# EasyEDA Pro project FOX_HTOL_1.0.eprj, board PCB1 (continued)
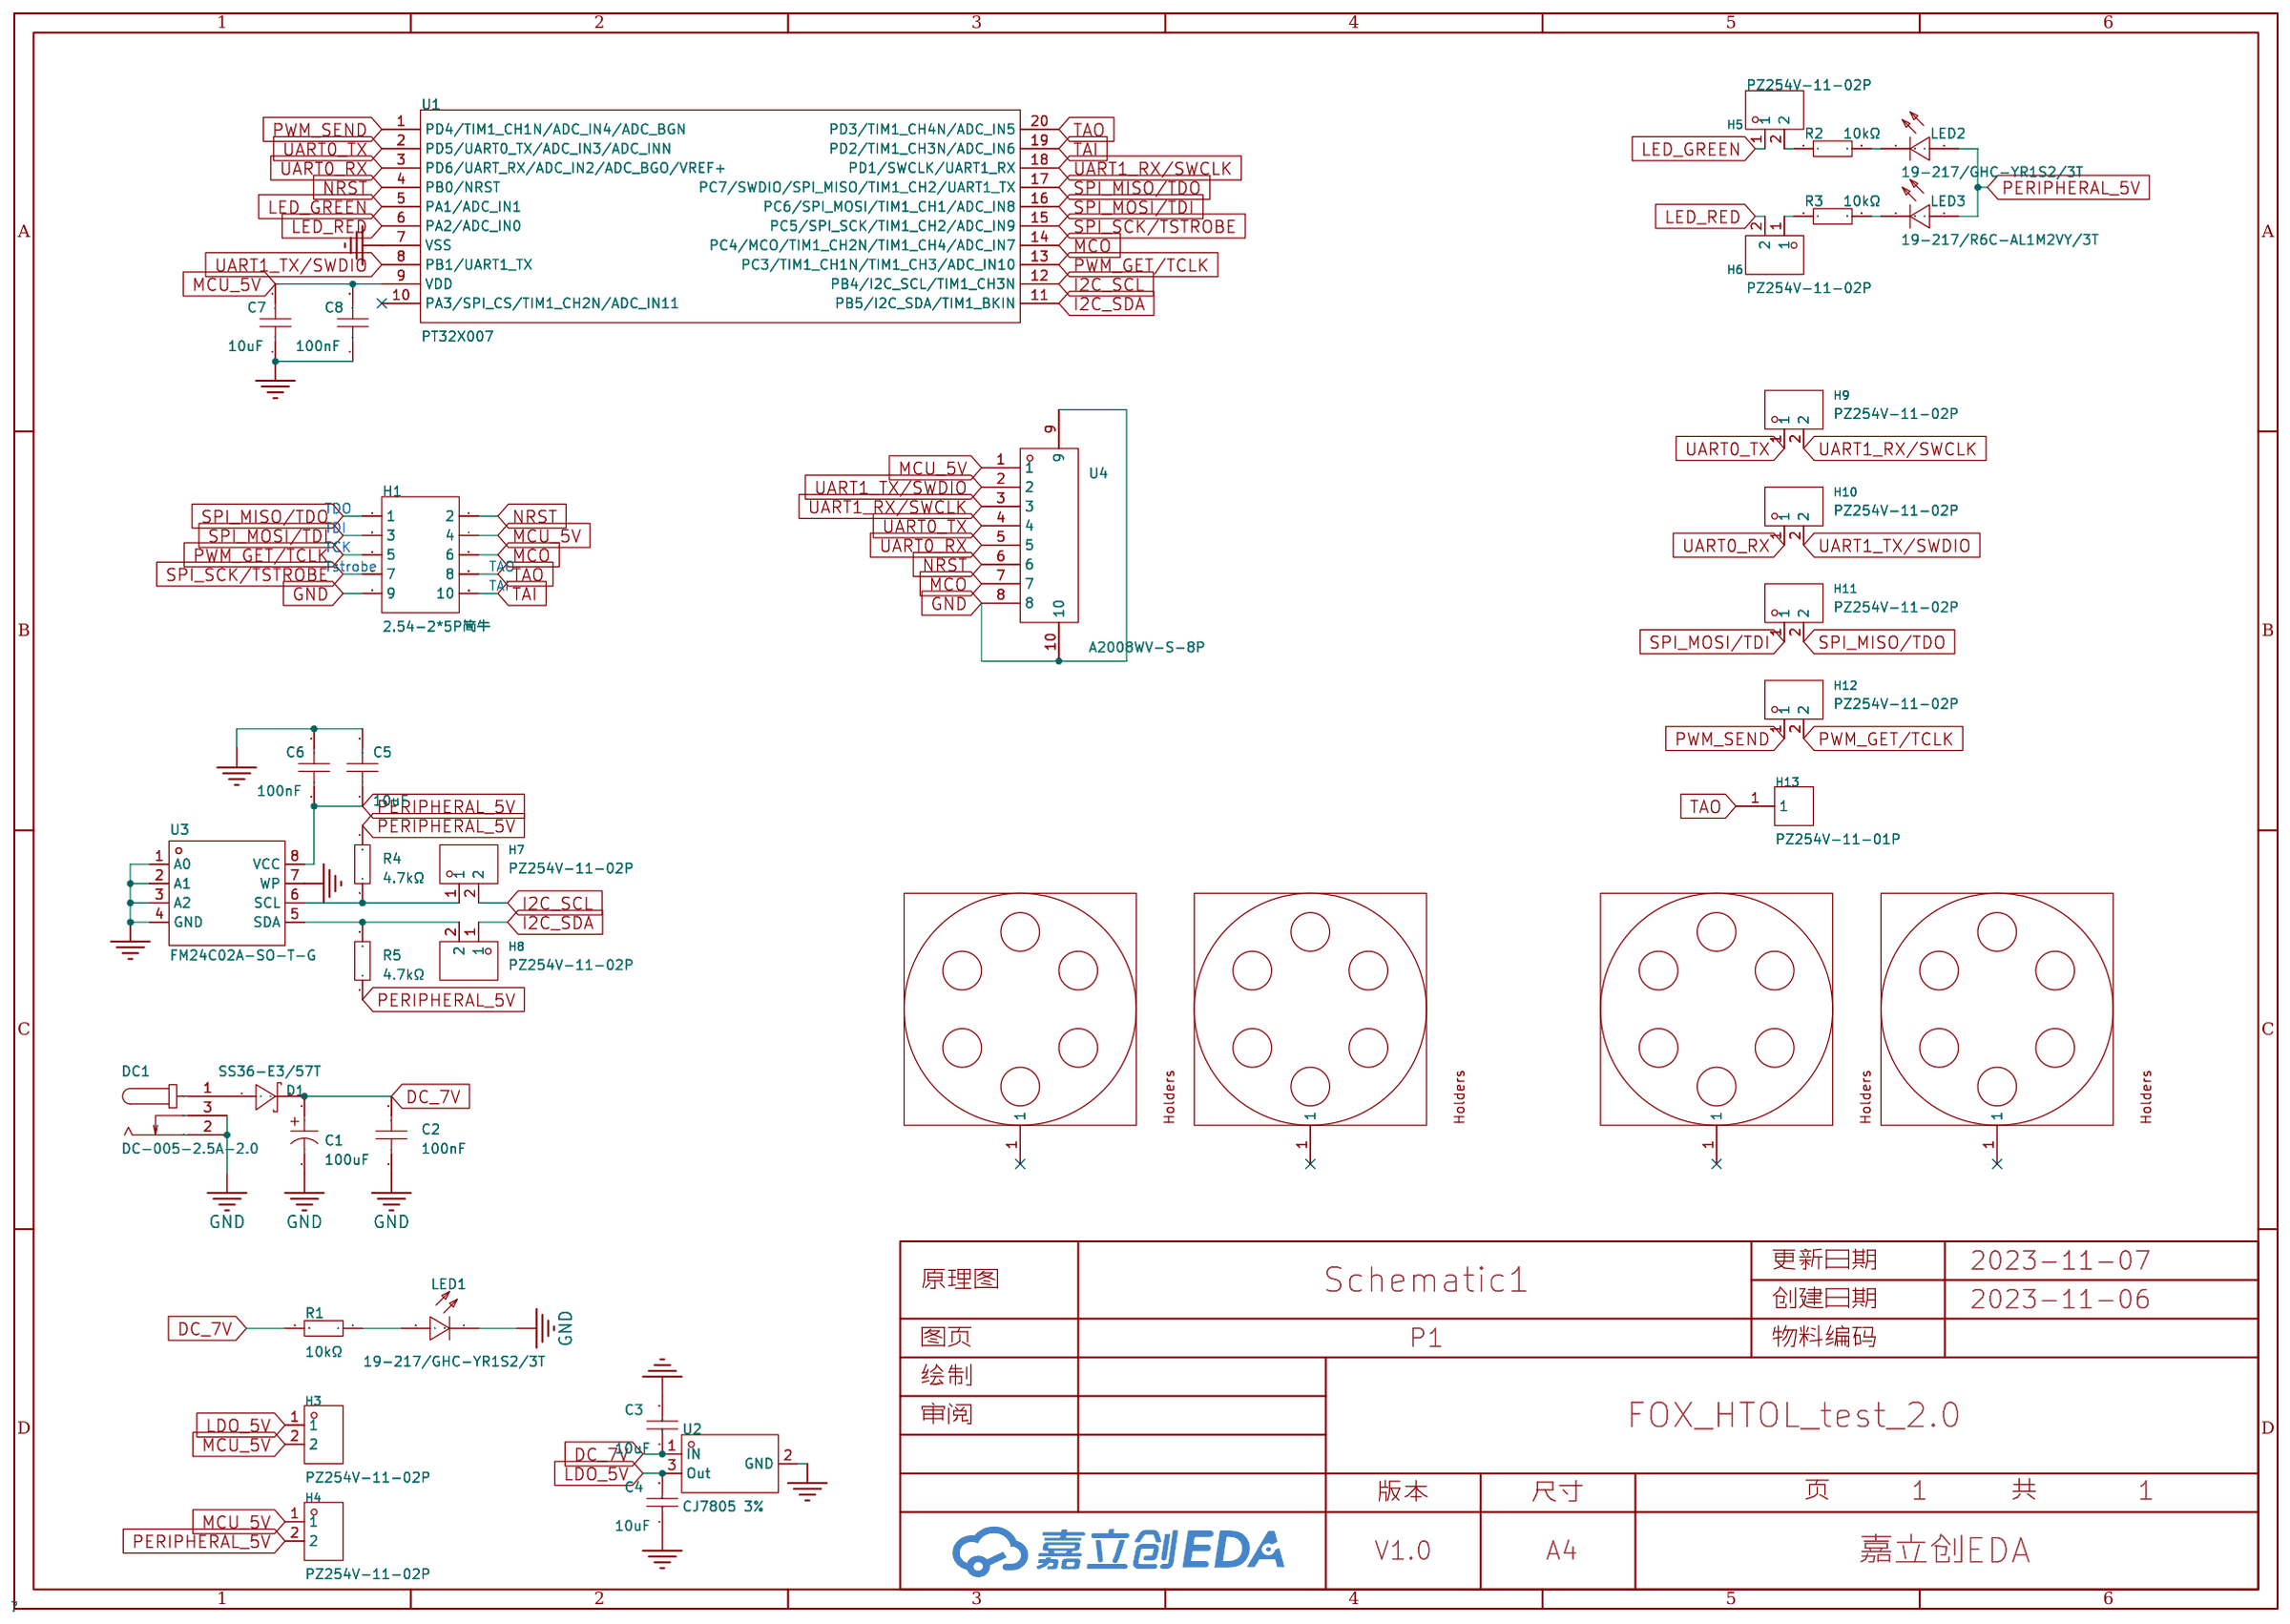
[diagram p0: schematic sheet]
## Placement (name value [footprint] x y rotation side) (continued)
H10#31  -  [HDR-TH_2P-P2.54-V-M]  46.04 191.02 180 top
H10#32  -  [HDR-TH_2P-P2.54-V-M]  46.04 94.65 180 top
H11  PZ254V-11-02P  [HDR-TH_2P-P2.54-V-M]  122.87 47.28 180 top
H11#2  -  [HDR-TH_2P-P2.54-V-M]  84.45 15.16 180 top
H11#3  -  [HDR-TH_2P-P2.54-V-M]  84.45 47.28 180 top
H11#4  -  [HDR-TH_2P-P2.54-V-M]  84.45 143.66 180 top
H11#5  -  [HDR-TH_2P-P2.54-V-M]  84.45 111.53 180 top
H11#6  -  [HDR-TH_2P-P2.54-V-M]  84.45 79.41 180 top
H11#7  -  [HDR-TH_2P-P2.54-V-M]  84.45 207.91 180 top
H11#8  -  [HDR-TH_2P-P2.54-V-M]  84.45 240.03 180 top
H11#9  -  [HDR-TH_2P-P2.54-V-M]  7.62 240.03 180 top
H11#10  -  [HDR-TH_2P-P2.54-V-M]  84.45 175.78 180 top
H11#11  -  [HDR-TH_2P-P2.54-V-M]  122.87 15.16 180 top
H11#12  -  [HDR-TH_2P-P2.54-V-M]  122.87 143.66 180 top
H11#13  -  [HDR-TH_2P-P2.54-V-M]  122.87 111.53 180 top
H11#14  -  [HDR-TH_2P-P2.54-V-M]  122.87 79.41 180 top
H11#15  -  [HDR-TH_2P-P2.54-V-M]  122.87 207.91 180 top
H11#16  -  [HDR-TH_2P-P2.54-V-M]  122.87 240.03 180 top
H11#17  -  [HDR-TH_2P-P2.54-V-M]  7.62 175.78 180 top
H11#18  -  [HDR-TH_2P-P2.54-V-M]  122.87 175.78 180 top
H11#19  -  [HDR-TH_2P-P2.54-V-M]  7.62 143.66 180 top
H11#20  -  [HDR-TH_2P-P2.54-V-M]  7.62 15.16 180 top
H11#21  -  [HDR-TH_2P-P2.54-V-M]  7.62 79.41 180 top
H11#22  -  [HDR-TH_2P-P2.54-V-M]  7.62 47.28 180 top
H11#23  -  [HDR-TH_2P-P2.54-V-M]  7.62 111.53 180 top
H11#24  -  [HDR-TH_2P-P2.54-V-M]  46.04 15.16 180 top
H11#25  -  [HDR-TH_2P-P2.54-V-M]  46.04 47.28 180 top
H11#26  -  [HDR-TH_2P-P2.54-V-M]  7.62 207.91 180 top
H11#27  -  [HDR-TH_2P-P2.54-V-M]  46.04 143.66 180 top
H11#28  -  [HDR-TH_2P-P2.54-V-M]  46.04 111.53 180 top
H11#29  -  [HDR-TH_2P-P2.54-V-M]  46.04 79.41 180 top
H11#30  -  [HDR-TH_2P-P2.54-V-M]  46.04 207.91 180 top
H11#31  -  [HDR-TH_2P-P2.54-V-M]  46.04 240.03 180 top
H11#32  -  [HDR-TH_2P-P2.54-V-M]  46.04 175.78 180 top
H12  PZ254V-11-02P  [HDR-TH_2P-P2.54-V-M]  84.45 228.23 180 top
H12#2  -  [HDR-TH_2P-P2.54-V-M]  84.45 131.85 180 top
H12#3  -  [HDR-TH_2P-P2.54-V-M]  84.45 99.73 180 top
H12#4  -  [HDR-TH_2P-P2.54-V-M]  84.45 35.48 180 top
H12#5  -  [HDR-TH_2P-P2.54-V-M]  84.45 260.35 180 top
H12#6  -  [HDR-TH_2P-P2.54-V-M]  84.45 196.1 180 top
H12#7  -  [HDR-TH_2P-P2.54-V-M]  84.45 163.98 180 top
H12#8  -  [HDR-TH_2P-P2.54-V-M]  84.45 67.6 180 top
H12#9  -  [HDR-TH_2P-P2.54-V-M]  122.87 35.48 180 top
H12#10  -  [HDR-TH_2P-P2.54-V-M]  7.62 260.35 180 top
H12#11  -  [HDR-TH_2P-P2.54-V-M]  122.87 228.23 180 top
H12#12  -  [HDR-TH_2P-P2.54-V-M]  122.87 131.85 180 top
H12#13  -  [HDR-TH_2P-P2.54-V-M]  122.87 99.73 180 top
H12#14  -  [HDR-TH_2P-P2.54-V-M]  122.87 260.35 180 top
H12#15  -  [HDR-TH_2P-P2.54-V-M]  122.87 196.1 180 top
H12#16  -  [HDR-TH_2P-P2.54-V-M]  122.87 163.98 180 top
H12#17  -  [HDR-TH_2P-P2.54-V-M]  122.87 67.6 180 top
H12#18  -  [HDR-TH_2P-P2.54-V-M]  7.62 163.98 180 top
H12#19  -  [HDR-TH_2P-P2.54-V-M]  7.62 35.48 180 top
H12#20  -  [HDR-TH_2P-P2.54-V-M]  7.62 67.6 180 top
H12#21  -  [HDR-TH_2P-P2.54-V-M]  7.62 99.73 180 top
H12#22  -  [HDR-TH_2P-P2.54-V-M]  7.62 131.85 180 top
H12#23  -  [HDR-TH_2P-P2.54-V-M]  7.62 228.23 180 top
H12#24  -  [HDR-TH_2P-P2.54-V-M]  46.04 228.23 180 top
H12#25  -  [HDR-TH_2P-P2.54-V-M]  46.04 131.85 180 top
H12#26  -  [HDR-TH_2P-P2.54-V-M]  46.04 99.73 180 top
H12#27  -  [HDR-TH_2P-P2.54-V-M]  46.04 35.48 180 top
H12#28  -  [HDR-TH_2P-P2.54-V-M]  46.04 260.35 180 top
H12#29  -  [HDR-TH_2P-P2.54-V-M]  46.04 196.1 180 top
H12#30  -  [HDR-TH_2P-P2.54-V-M]  46.04 163.98 180 top
H12#31  -  [HDR-TH_2P-P2.54-V-M]  46.04 67.6 180 top
H12#32  -  [HDR-TH_2P-P2.54-V-M]  7.62 196.1 180 top
H13  PZ254V-11-01P  [HDR-TH_1P-P2.54-V-M]  106.04 122.07 0 top
H13#2  -  [HDR-TH_1P-P2.54-V-M]  106.04 57.82 0 top
H13#3  -  [HDR-TH_1P-P2.54-V-M]  106.04 25.7 0 top
H13#4  -  [HDR-TH_1P-P2.54-V-M]  106.04 250.57 0 top
H13#5  -  [HDR-TH_1P-P2.54-V-M]  106.04 218.45 0 top
H13#6  -  [HDR-TH_1P-P2.54-V-M]  106.04 154.2 0 top
H13#7  -  [HDR-TH_1P-P2.54-V-M]  106.04 186.32 0 top
H13#8  -  [HDR-TH_1P-P2.54-V-M]  106.04 89.95 0 top
H13#9  -  [HDR-TH_1P-P2.54-V-M]  144.46 122.07 0 top
H13#10  -  [HDR-TH_1P-P2.54-V-M]  144.46 57.82 0 top
H13#11  -  [HDR-TH_1P-P2.54-V-M]  144.46 25.7 0 top
H13#12  -  [HDR-TH_1P-P2.54-V-M]  144.46 250.57 0 top
H13#13  -  [HDR-TH_1P-P2.54-V-M]  144.46 218.45 0 top
H13#14  -  [HDR-TH_1P-P2.54-V-M]  144.46 154.2 0 top
H13#15  -  [HDR-TH_1P-P2.54-V-M]  29.21 186.32 0 top
H13#16  -  [HDR-TH_1P-P2.54-V-M]  144.46 186.32 0 top
H13#17  -  [HDR-TH_1P-P2.54-V-M]  144.46 89.95 0 top
H13#18  -  [HDR-TH_1P-P2.54-V-M]  29.21 154.2 0 top
H13#19  -  [HDR-TH_1P-P2.54-V-M]  29.21 25.7 0 top
H13#20  -  [HDR-TH_1P-P2.54-V-M]  29.21 89.95 0 top
H13#21  -  [HDR-TH_1P-P2.54-V-M]  29.21 57.82 0 top
H13#22  -  [HDR-TH_1P-P2.54-V-M]  29.21 122.07 0 top
H13#23  -  [HDR-TH_1P-P2.54-V-M]  67.63 122.07 0 top
H13#24  -  [HDR-TH_1P-P2.54-V-M]  29.21 218.45 0 top
H13#25  -  [HDR-TH_1P-P2.54-V-M]  67.63 57.82 0 top
H13#26  -  [HDR-TH_1P-P2.54-V-M]  67.63 25.7 0 top
H13#27  -  [HDR-TH_1P-P2.54-V-M]  67.63 250.57 0 top
H13#28  -  [HDR-TH_1P-P2.54-V-M]  67.63 218.45 0 top
H13#29  -  [HDR-TH_1P-P2.54-V-M]  67.63 154.2 0 top
H13#30  -  [HDR-TH_1P-P2.54-V-M]  29.21 250.57 0 top
H13#31  -  [HDR-TH_1P-P2.54-V-M]  67.63 186.32 0 top
H13#32  -  [HDR-TH_1P-P2.54-V-M]  67.63 89.95 0 top
J2  -  [DEMO板安装孔]  152.23 273.68 0 top
J3  -  [DEMO板安装孔]  9.52 273.68 0 top
J4  -  [DEMO板安装孔]  9.27 5.07 0 top
J5  -  [DEMO板安装孔]  152.02 4.95 0 top
LED1  19-217/GHC-YR1S2/3T  [LED0603-RD]  34.8 279.4 90 top
LED2  19-217/GHC-YR1S2/3T  [LED0603-RD]  25.55 238.52 180 top
LED2#2  -  [LED0603-RD]  102.38 13.65 180 top
LED2#3  -  [LED0603-RD]  102.38 238.52 180 top
LED2#4  -  [LED0603-RD]  102.38 206.39 180 top
LED2#5  -  [LED0603-RD]  102.38 174.27 180 top
LED2#6  -  [LED0603-RD]  25.55 174.27 180 top
LED2#7  -  [LED0603-RD]  102.38 45.77 180 top
LED2#8  -  [LED0603-RD]  102.38 142.14 180 top
LED2#9  -  [LED0603-RD]  102.38 110.02 180 top
LED2#10  -  [LED0603-RD]  102.38 77.89 180 top
LED2#11  -  [LED0603-RD]  140.8 13.65 180 top
LED2#12  -  [LED0603-RD]  140.8 238.52 180 top
LED2#13  -  [LED0603-RD]  140.8 206.39 180 top
LED2#14  -  [LED0603-RD]  140.8 174.27 180 top
LED2#15  -  [LED0603-RD]  140.8 45.77 180 top
LED2#16  -  [LED0603-RD]  140.8 142.14 180 top
LED2#17  -  [LED0603-RD]  140.8 110.02 180 top
LED2#18  -  [LED0603-RD]  140.8 77.89 180 top
LED2#19  -  [LED0603-RD]  25.55 142.14 180 top
LED2#20  -  [LED0603-RD]  25.55 13.65 180 top
LED2#21  -  [LED0603-RD]  25.55 77.89 180 top
LED2#22  -  [LED0603-RD]  25.55 45.77 180 top
LED2#23  -  [LED0603-RD]  25.55 110.02 180 top
LED2#24  -  [LED0603-RD]  25.55 206.39 180 top
LED2#25  -  [LED0603-RD]  63.97 13.65 180 top
LED2#26  -  [LED0603-RD]  63.97 238.52 180 top
LED2#27  -  [LED0603-RD]  63.97 206.39 180 top
LED2#28  -  [LED0603-RD]  63.97 174.27 180 top
LED2#29  -  [LED0603-RD]  63.97 45.77 180 top
LED2#30  -  [LED0603-RD]  63.97 142.14 180 top
LED2#31  -  [LED0603-RD]  63.97 110.02 180 top
LED2#32  -  [LED0603-RD]  63.97 77.89 180 top
LED3  19-217/R6C-AL1M2VY/3T  [LED0603-RD]  102.36 144.04 180 top
LED3#2  -  [LED0603-RD]  25.53 176.16 180 top
LED3#3  -  [LED0603-RD]  25.53 240.41 180 top
LED3#4  -  [LED0603-RD]  102.36 15.54 180 top
LED3#5  -  [LED0603-RD]  102.36 208.29 180 top
LED3#6  -  [LED0603-RD]  102.36 79.79 180 top
LED3#7  -  [LED0603-RD]  102.36 240.41 180 top
LED3#8  -  [LED0603-RD]  102.36 47.66 180 top
LED3#9  -  [LED0603-RD]  102.36 176.16 180 top
LED3#10  -  [LED0603-RD]  102.36 111.91 180 top
LED3#11  -  [LED0603-RD]  140.77 15.54 180 top
LED3#12  -  [LED0603-RD]  140.77 208.29 180 top
LED3#13  -  [LED0603-RD]  140.77 79.79 180 top
LED3#14  -  [LED0603-RD]  140.77 240.41 180 top
LED3#15  -  [LED0603-RD]  140.77 144.04 180 top
LED3#16  -  [LED0603-RD]  140.77 47.66 180 top
LED3#17  -  [LED0603-RD]  140.77 176.16 180 top
LED3#18  -  [LED0603-RD]  140.77 111.91 180 top
LED3#19  -  [LED0603-RD]  25.53 144.04 180 top
LED3#20  -  [LED0603-RD]  25.53 15.54 180 top
LED3#21  -  [LED0603-RD]  25.53 79.79 180 top
LED3#22  -  [LED0603-RD]  25.53 47.66 180 top
LED3#23  -  [LED0603-RD]  25.53 111.91 180 top
LED3#24  -  [LED0603-RD]  25.53 208.29 180 top
LED3#25  -  [LED0603-RD]  63.94 15.54 180 top
LED3#26  -  [LED0603-RD]  63.94 208.29 180 top
LED3#27  -  [LED0603-RD]  63.94 79.79 180 top
LED3#28  -  [LED0603-RD]  63.94 240.41 180 top
LED3#29  -  [LED0603-RD]  63.94 144.04 180 top
LED3#30  -  [LED0603-RD]  63.94 47.66 180 top
LED3#31  -  [LED0603-RD]  63.94 176.16 180 top
LED3#32  -  [LED0603-RD]  63.94 111.91 180 top
R1  10kΩ  [R0603]  34.8 282.45 90 top
R2  10kΩ  [R0603]  28.7 238.51 180 top
R2#2  -  [R0603]  105.53 142.13 180 top
R2#3  -  [R0603]  105.53 13.63 180 top
R2#4  -  [R0603]  105.53 206.38 180 top
R2#5  -  [R0603]  105.53 174.26 180 top
R2#6  -  [R0603]  28.7 174.26 180 top
R2#7  -  [R0603]  105.53 77.88 180 top
R2#8  -  [R0603]  105.53 45.76 180 top
R2#9  -  [R0603]  105.53 238.51 180 top
R2#10  -  [R0603]  105.53 110.01 180 top
R2#11  -  [R0603]  143.95 142.13 180 top
R2#12  -  [R0603]  143.95 13.63 180 top
R2#13  -  [R0603]  143.95 206.38 180 top
R2#14  -  [R0603]  143.95 174.26 180 top
R2#15  -  [R0603]  143.95 77.88 180 top
R2#16  -  [R0603]  143.95 45.76 180 top
R2#17  -  [R0603]  143.95 238.51 180 top
R2#18  -  [R0603]  143.95 110.01 180 top
R2#19  -  [R0603]  28.7 142.13 180 top
R2#20  -  [R0603]  28.7 13.63 180 top
R2#21  -  [R0603]  28.7 77.88 180 top
R2#22  -  [R0603]  28.7 45.76 180 top
R2#23  -  [R0603]  28.7 110.01 180 top
R2#24  -  [R0603]  28.7 206.38 180 top
R2#25  -  [R0603]  67.12 142.13 180 top
R2#26  -  [R0603]  67.12 13.63 180 top
R2#27  -  [R0603]  67.12 206.38 180 top
R2#28  -  [R0603]  67.12 174.26 180 top
R2#29  -  [R0603]  67.12 77.88 180 top
R2#30  -  [R0603]  67.12 45.76 180 top
R2#31  -  [R0603]  67.12 238.51 180 top
R2#32  -  [R0603]  67.12 110.01 180 top
R3  10kΩ  [R0603]  105.54 79.79 180 top
R3#2  -  [R0603]  28.71 240.41 180 top
R3#3  -  [R0603]  105.54 208.29 180 top
R3#4  -  [R0603]  105.54 144.04 180 top
R3#5  -  [R0603]  105.54 111.92 180 top
R3#6  -  [R0603]  105.54 15.54 180 top
R3#7  -  [R0603]  105.54 47.67 180 top
R3#8  -  [R0603]  105.54 240.41 180 top
R3#9  -  [R0603]  105.54 176.17 180 top
R3#10  -  [R0603]  143.95 79.79 180 top
R3#11  -  [R0603]  28.71 176.17 180 top
R3#12  -  [R0603]  143.95 208.29 180 top
R3#13  -  [R0603]  143.95 144.04 180 top
R3#14  -  [R0603]  143.95 111.92 180 top
R3#15  -  [R0603]  143.95 15.54 180 top
R3#16  -  [R0603]  143.95 47.67 180 top
R3#17  -  [R0603]  143.95 240.41 180 top
R3#18  -  [R0603]  143.95 176.17 180 top
R3#19  -  [R0603]  28.71 144.04 180 top
R3#20  -  [R0603]  28.71 79.79 180 top
R3#21  -  [R0603]  28.71 15.54 180 top
R3#22  -  [R0603]  28.71 47.67 180 top
R3#23  -  [R0603]  28.71 111.92 180 top
R3#24  -  [R0603]  28.71 208.29 180 top
R3#25  -  [R0603]  67.12 79.79 180 top
R3#26  -  [R0603]  67.12 208.29 180 top
R3#27  -  [R0603]  67.12 144.04 180 top
R3#28  -  [R0603]  67.12 111.92 180 top
R3#29  -  [R0603]  67.12 15.54 180 top
R3#30  -  [R0603]  67.12 47.67 180 top
R3#31  -  [R0603]  67.12 240.41 180 top
R3#32  -  [R0603]  67.12 176.17 180 top
R4  4.7kΩ  [R0603]  98.04 142.26 0 top
R4#2  -  [R0603]  98.04 206.51 0 top
R4#3  -  [R0603]  21.21 238.63 0 top
R4#4  -  [R0603]  98.04 78.01 0 top
R4#5  -  [R0603]  98.04 13.76 0 top
R4#6  -  [R0603]  98.04 45.89 0 top
R4#7  -  [R0603]  98.04 238.63 0 top
R4#8  -  [R0603]  98.04 174.38 0 top
R4#9  -  [R0603]  98.04 110.14 0 top
R4#10  -  [R0603]  136.46 206.51 0 top
R4#11  -  [R0603]  136.46 78.01 0 top
R4#12  -  [R0603]  136.46 13.76 0 top
R4#13  -  [R0603]  136.46 142.26 0 top
R4#14  -  [R0603]  136.46 45.89 0 top
R4#15  -  [R0603]  136.46 238.63 0 top
R4#16  -  [R0603]  136.46 174.38 0 top
R4#17  -  [R0603]  21.21 174.38 0 top
R4#18  -  [R0603]  136.46 110.14 0 top
R4#19  -  [R0603]  21.21 142.26 0 top
R4#20  -  [R0603]  21.21 78.01 0 top
R4#21  -  [R0603]  21.21 13.76 0 top
R4#22  -  [R0603]  21.21 45.89 0 top
R4#23  -  [R0603]  21.21 110.14 0 top
R4#24  -  [R0603]  21.21 206.51 0 top
R4#25  -  [R0603]  59.62 206.51 0 top
R4#26  -  [R0603]  59.62 78.01 0 top
R4#27  -  [R0603]  59.62 13.76 0 top
R4#28  -  [R0603]  59.62 142.26 0 top
R4#29  -  [R0603]  59.62 45.89 0 top
R4#30  -  [R0603]  59.62 238.63 0 top
R4#31  -  [R0603]  59.62 174.38 0 top
R4#32  -  [R0603]  59.62 110.14 0 top
R5  4.7kΩ  [R0603]  21.21 108.61 180 top
R5#2  -  [R0603]  98.04 140.74 180 top
R5#3  -  [R0603]  98.04 108.61 180 top
R5#4  -  [R0603]  21.21 237.11 180 top
R5#5  -  [R0603]  98.04 76.49 180 top
R5#6  -  [R0603]  98.04 204.98 180 top
R5#7  -  [R0603]  98.04 172.86 180 top
R5#8  -  [R0603]  98.04 44.36 180 top
R5#9  -  [R0603]  98.04 237.11 180 top
R5#10  -  [R0603]  136.46 12.24 180 top
R5#11  -  [R0603]  136.46 140.74 180 top
R5#12  -  [R0603]  136.46 108.61 180 top
R5#13  -  [R0603]  136.46 76.49 180 top
R5#14  -  [R0603]  136.46 204.98 180 top
R5#15  -  [R0603]  136.46 172.86 180 top
R5#16  -  [R0603]  136.46 44.36 180 top
R5#17  -  [R0603]  136.46 237.11 180 top
R5#18  -  [R0603]  21.21 172.86 180 top
R5#19  -  [R0603]  21.21 140.74 180 top
R5#20  -  [R0603]  21.21 12.24 180 top
R5#21  -  [R0603]  21.21 76.49 180 top
R5#22  -  [R0603]  21.21 44.36 180 top
R5#23  -  [R0603]  59.62 12.24 180 top
R5#24  -  [R0603]  59.62 140.74 180 top
R5#25  -  [R0603]  59.62 108.61 180 top
R5#26  -  [R0603]  59.62 76.49 180 top
R5#27  -  [R0603]  59.62 204.98 180 top
R5#28  -  [R0603]  59.62 172.86 180 top
R5#29  -  [R0603]  21.21 204.98 180 top
R5#30  -  [R0603]  59.62 44.36 180 top
R5#31  -  [R0603]  59.62 237.11 180 top
R5#32  -  [R0603]  98.04 12.24 180 top
U1  PT32X007  [TSSOP-20_L6.5-W4.4-P0.65-LS6.4-BL]  21.08 248.16 270 top
U1#2  -  [TSSOP-20_L6.5-W4.4-P0.65-LS6.4-BL]  97.91 119.66 270 top
U1#3  -  [TSSOP-20_L6.5-W4.4-P0.65-LS6.4-BL]  97.91 55.41 270 top
U1#4  -  [TSSOP-20_L6.5-W4.4-P0.65-LS6.4-BL]  97.91 23.29 270 top
U1#5  -  [TSSOP-20_L6.5-W4.4-P0.65-LS6.4-BL]  97.91 216.03 270 top
U1#6  -  [TSSOP-20_L6.5-W4.4-P0.65-LS6.4-BL]  97.91 87.54 270 top
U1#7  -  [TSSOP-20_L6.5-W4.4-P0.65-LS6.4-BL]  97.91 248.16 270 top
U1#8  -  [TSSOP-20_L6.5-W4.4-P0.65-LS6.4-BL]  97.91 183.91 270 top
U1#9  -  [TSSOP-20_L6.5-W4.4-P0.65-LS6.4-BL]  97.91 151.78 270 top
U1#10  -  [TSSOP-20_L6.5-W4.4-P0.65-LS6.4-BL]  136.33 119.66 270 top
U1#11  -  [TSSOP-20_L6.5-W4.4-P0.65-LS6.4-BL]  136.33 55.41 270 top
U1#12  -  [TSSOP-20_L6.5-W4.4-P0.65-LS6.4-BL]  136.33 23.29 270 top
U1#13  -  [TSSOP-20_L6.5-W4.4-P0.65-LS6.4-BL]  136.33 216.03 270 top
U1#14  -  [TSSOP-20_L6.5-W4.4-P0.65-LS6.4-BL]  136.33 87.54 270 top
U1#15  -  [TSSOP-20_L6.5-W4.4-P0.65-LS6.4-BL]  136.33 248.16 270 top
U1#16  -  [TSSOP-20_L6.5-W4.4-P0.65-LS6.4-BL]  136.33 183.91 270 top
U1#17  -  [TSSOP-20_L6.5-W4.4-P0.65-LS6.4-BL]  136.33 151.78 270 top
U1#18  -  [TSSOP-20_L6.5-W4.4-P0.65-LS6.4-BL]  21.08 151.78 270 top
U1#19  -  [TSSOP-20_L6.5-W4.4-P0.65-LS6.4-BL]  21.08 23.29 270 top
U1#20  -  [TSSOP-20_L6.5-W4.4-P0.65-LS6.4-BL]  21.08 87.54 270 top
U1#21  -  [TSSOP-20_L6.5-W4.4-P0.65-LS6.4-BL]  21.08 55.41 270 top
U1#22  -  [TSSOP-20_L6.5-W4.4-P0.65-LS6.4-BL]  21.08 119.66 270 top
U1#23  -  [TSSOP-20_L6.5-W4.4-P0.65-LS6.4-BL]  21.08 216.03 270 top
U1#24  -  [TSSOP-20_L6.5-W4.4-P0.65-LS6.4-BL]  59.5 119.66 270 top
U1#25  -  [TSSOP-20_L6.5-W4.4-P0.65-LS6.4-BL]  59.5 55.41 270 top
U1#26  -  [TSSOP-20_L6.5-W4.4-P0.65-LS6.4-BL]  59.5 23.29 270 top
U1#27  -  [TSSOP-20_L6.5-W4.4-P0.65-LS6.4-BL]  59.5 216.03 270 top
U1#28  -  [TSSOP-20_L6.5-W4.4-P0.65-LS6.4-BL]  59.5 87.54 270 top
U1#29  -  [TSSOP-20_L6.5-W4.4-P0.65-LS6.4-BL]  59.5 248.16 270 top
U1#30  -  [TSSOP-20_L6.5-W4.4-P0.65-LS6.4-BL]  59.5 183.91 270 top
U1#31  -  [TSSOP-20_L6.5-W4.4-P0.65-LS6.4-BL]  21.08 183.91 270 top
U1#32  -  [TSSOP-20_L6.5-W4.4-P0.65-LS6.4-BL]  59.5 151.78 270 top
U2  CJ7805 3%  [TO-252-2_L6.6-W6.1-P4.58-LS10.1-BR-CW]  57.62 280.98 180 top
U2#2  -  [TO-252-2_L6.6-W6.1-P4.58-LS10.1-BR-CW]  72.35 280.98 180 top
U2#3  -  [TO-252-2_L6.6-W6.1-P4.58-LS10.1-BR-CW]  42.8 280.92 180 top
U2#4  -  [TO-252-2_L6.6-W6.1-P4.58-LS10.1-BR-CW]  87.09 280.98 180 top
U3  FM24C02A-SO-T-G  [SOP-8_L5.0-W4.0-P1.27-LS6.2-BL]  92.58 47.28 270 top
U3#2  -  [SOP-8_L5.0-W4.0-P1.27-LS6.2-BL]  92.58 207.91 270 top
U3#3  -  [SOP-8_L5.0-W4.0-P1.27-LS6.2-BL]  92.58 15.16 270 top
U3#4  -  [SOP-8_L5.0-W4.0-P1.27-LS6.2-BL]  92.58 240.03 270 top
U3#5  -  [SOP-8_L5.0-W4.0-P1.27-LS6.2-BL]  15.75 240.03 270 top
U3#6  -  [SOP-8_L5.0-W4.0-P1.27-LS6.2-BL]  92.58 175.78 270 top
U3#7  -  [SOP-8_L5.0-W4.0-P1.27-LS6.2-BL]  92.58 143.66 270 top
U3#8  -  [SOP-8_L5.0-W4.0-P1.27-LS6.2-BL]  92.58 111.53 270 top
U3#9  -  [SOP-8_L5.0-W4.0-P1.27-LS6.2-BL]  92.58 79.41 270 top
U3#10  -  [SOP-8_L5.0-W4.0-P1.27-LS6.2-BL]  131 47.28 270 top
U3#11  -  [SOP-8_L5.0-W4.0-P1.27-LS6.2-BL]  131 207.91 270 top
U3#12  -  [SOP-8_L5.0-W4.0-P1.27-LS6.2-BL]  131 15.16 270 top
U3#13  -  [SOP-8_L5.0-W4.0-P1.27-LS6.2-BL]  131 240.03 270 top
U3#14  -  [SOP-8_L5.0-W4.0-P1.27-LS6.2-BL]  131 175.78 270 top
U3#15  -  [SOP-8_L5.0-W4.0-P1.27-LS6.2-BL]  131 143.66 270 top
U3#16  -  [SOP-8_L5.0-W4.0-P1.27-LS6.2-BL]  131 111.53 270 top
U3#17  -  [SOP-8_L5.0-W4.0-P1.27-LS6.2-BL]  131 79.41 270 top
U3#18  -  [SOP-8_L5.0-W4.0-P1.27-LS6.2-BL]  15.75 175.78 270 top
U3#19  -  [SOP-8_L5.0-W4.0-P1.27-LS6.2-BL]  15.75 143.66 270 top
U3#20  -  [SOP-8_L5.0-W4.0-P1.27-LS6.2-BL]  15.75 79.41 270 top
U3#21  -  [SOP-8_L5.0-W4.0-P1.27-LS6.2-BL]  15.75 15.16 270 top
U3#22  -  [SOP-8_L5.0-W4.0-P1.27-LS6.2-BL]  15.75 47.28 270 top
U3#23  -  [SOP-8_L5.0-W4.0-P1.27-LS6.2-BL]  15.75 111.53 270 top
U3#24  -  [SOP-8_L5.0-W4.0-P1.27-LS6.2-BL]  15.75 207.91 270 top
U3#25  -  [SOP-8_L5.0-W4.0-P1.27-LS6.2-BL]  54.16 47.28 270 top
U3#26  -  [SOP-8_L5.0-W4.0-P1.27-LS6.2-BL]  54.16 207.91 270 top
U3#27  -  [SOP-8_L5.0-W4.0-P1.27-LS6.2-BL]  54.16 15.16 270 top
U3#28  -  [SOP-8_L5.0-W4.0-P1.27-LS6.2-BL]  54.16 240.03 270 top
U3#29  -  [SOP-8_L5.0-W4.0-P1.27-LS6.2-BL]  54.16 175.78 270 top
U3#30  -  [SOP-8_L5.0-W4.0-P1.27-LS6.2-BL]  54.16 143.66 270 top
U3#31  -  [SOP-8_L5.0-W4.0-P1.27-LS6.2-BL]  54.16 111.53 270 top
U3#32  -  [SOP-8_L5.0-W4.0-P1.27-LS6.2-BL]  54.16 79.41 270 top
U4  A2008WV-S-8P  [CONN-SMD_A2008WV-S-8P]  113.66 90.96 270 top
U4#2  -  [CONN-SMD_A2008WV-S-8P]  113.66 58.84 270 top
U4#3  -  [CONN-SMD_A2008WV-S-8P]  113.66 26.72 270 top
U4#4  -  [CONN-SMD_A2008WV-S-8P]  113.66 187.34 270 top
U4#5  -  [CONN-SMD_A2008WV-S-8P]  113.66 155.21 270 top
U4#6  -  [CONN-SMD_A2008WV-S-8P]  113.66 251.59 270 top
U4#7  -  [CONN-SMD_A2008WV-S-8P]  113.66 219.46 270 top
U4#8  -  [CONN-SMD_A2008WV-S-8P]  113.66 123.09 270 top
U4#9  -  [CONN-SMD_A2008WV-S-8P]  36.83 251.59 270 top
U4#10  -  [CONN-SMD_A2008WV-S-8P]  152.08 90.96 270 top
U4#11  -  [CONN-SMD_A2008WV-S-8P]  152.08 58.84 270 top
U4#12  -  [CONN-SMD_A2008WV-S-8P]  152.08 26.72 270 top
U4#13  -  [CONN-SMD_A2008WV-S-8P]  152.08 187.34 270 top
U4#14  -  [CONN-SMD_A2008WV-S-8P]  152.08 155.21 270 top
U4#15  -  [CONN-SMD_A2008WV-S-8P]  152.08 251.59 270 top
U4#16  -  [CONN-SMD_A2008WV-S-8P]  152.08 219.46 270 top
U4#17  -  [CONN-SMD_A2008WV-S-8P]  152.08 123.09 270 top
U4#18  -  [CONN-SMD_A2008WV-S-8P]  36.83 187.34 270 top
U4#19  -  [CONN-SMD_A2008WV-S-8P]  36.83 155.21 270 top
U4#20  -  [CONN-SMD_A2008WV-S-8P]  36.83 26.72 270 top
U4#21  -  [CONN-SMD_A2008WV-S-8P]  36.83 58.84 270 top
U4#22  -  [CONN-SMD_A2008WV-S-8P]  36.83 90.96 270 top
U4#23  -  [CONN-SMD_A2008WV-S-8P]  36.83 123.09 270 top
U4#24  -  [CONN-SMD_A2008WV-S-8P]  75.25 90.96 270 top
U4#25  -  [CONN-SMD_A2008WV-S-8P]  75.25 58.84 270 top
U4#26  -  [CONN-SMD_A2008WV-S-8P]  75.25 26.72 270 top
U4#27  -  [CONN-SMD_A2008WV-S-8P]  75.25 187.34 270 top
U4#28  -  [CONN-SMD_A2008WV-S-8P]  75.25 155.21 270 top
U4#29  -  [CONN-SMD_A2008WV-S-8P]  75.25 251.59 270 top
U4#30  -  [CONN-SMD_A2008WV-S-8P]  75.25 219.46 270 top
U4#31  -  [CONN-SMD_A2008WV-S-8P]  36.83 219.46 270 top
U4#32  -  [CONN-SMD_A2008WV-S-8P]  75.25 123.09 270 top

## Footprints (pads in the part's own frame, mm; a bottom-side part is the same pattern mirrored in y, then rotated)
C0603
  rect 0.8x0.9 smd: 1(-0.7,0) 2(0.7,0)
C1206
  rect 1.485x1.728 smd: 1(-1.593,0) 2(1.593,0)
CAP-SMD_BD6.3-L6.6-W6.6-LS7.6-FD-1
  rect 3.5x1.2 smd: 1(-2.67,0) 2(2.67,0)
CONN-SMD_A2008WV-S-8P
  rect 1x2.5 smd: 1(-7,1.724) 2(-5,1.724) 3(-3,1.724) 4(-1,1.724) 5(1,1.724) 6(2.999,1.724) 7(5,1.724) 8(7,1.724)
  rect 1.55x2.6 smd: 9(-9.575,-1.724) 10(9.575,-1.724)
CONN-TH_DC-005-2.5A-2.0
  oval 1.8x4.2 hole 1.2x3.7: 1(2.999,2.35) 2(-2.999,2.35)
  oval 4.2x1.8 hole 3.7x1.2: 3(0,-2.35)
DEMO板安装孔
  round 6.32 hole 3: 1(0,0)
HDR-TH_1P-P2.54-V-M
  rect 1.7x1.7 hole 1.1: 1(0,0)
HDR-TH_2P-P2.54-V-M
  rect 2x2 hole 1.2: 1(-1.27,0)
  round 2 hole 1.2: 2(1.27,0)
IDC-TH_10P-P2.54_C5665
  round 1.524 hole 1: 1(-5.08,-1.27) 2(-5.08,1.27) 3(-2.54,-1.27) 4(-2.54,1.27) 5(0,-1.27) 6(0,1.27) 7(2.54,-1.27) 8(2.54,1.27) 9(5.08,-1.27) 10(5.08,1.27)
LED0603-RD
  rect 0.8x0.8 smd: 1(-0.799,-0.004) 2(0.799,0.004)
R0603
  rect 0.806x0.864 smd: 1(-0.753,0) 2(0.753,0)
SMC_L7.1-W6.2-LS8.1-R-RD
  rect 3.03x3.82 smd: 1(3.435,0) 2(-3.435,0)
SOP-8_L5.0-W4.0-P1.27-LS6.2-BL
  oval 0.7x1.7 smd: 1(-1.905,-2.9) 2(-0.635,-2.9) 3(0.635,-2.9) 4(1.905,-2.9) 5(1.905,2.9) 6(0.635,2.9) 7(-0.635,2.9) 8(-1.905,2.9)
TO-252-2_L6.6-W6.1-P4.58-LS10.1-BR-CW
  rect 2.364x1.064 smd: 1(3.462,-2.286) 3(3.462,2.286)
  rect 6.004x5.512 smd: 2(-3.462,0)
TSSOP-20_L6.5-W4.4-P0.65-LS6.4-BL
  oval 0.364x1.742 smd: 1(-2.925,-2.871) 2(-2.275,-2.871) 3(-1.625,-2.871) 4(-0.975,-2.871) 5(-0.325,-2.871) 6(0.325,-2.871) 7(0.975,-2.871) 8(1.625,-2.871) 9(2.275,-2.871) 10(2.925,-2.871) 11(2.925,2.871) 12(2.275,2.871) 13(1.625,2.871) 14(0.975,2.871) 15(0.325,2.871) 16(-0.325,2.871) 17(-0.975,2.871) 18(-1.625,2.871) 19(-2.275,2.871) 20(-2.925,2.871)

## Nets
GND: C1.2 C2.1 C3.2 C3#2.2 C3#3.2 C3#4.2 C4.1 C4#2.1 C4#3.1 C4#4.1 C5.2 C5#2.2 C5#3.2 C5#4.2 C5#5.2 C5#6.2 C5#7.2 C5#8.2 C5#9.2 C5#10.2 C5#11.2 C5#12.2 C5#13.2 C5#14.2 C5#15.2 C5#16.2 C5#17.2 C5#18.2 C5#19.2 C5#20.2 C5#21.2 C5#22.2 C5#23.2 C5#24.2 C5#25.2 C5#26.2 C5#27.2 C5#28.2 C5#29.2 C5#30.2 C5#31.2 C5#32.2 C6.2 C6#2.2 C6#3.2 C6#4.2 C6#5.2 C6#6.2 C6#7.2 C6#8.2 C6#9.2 C6#10.2 C6#11.2 C6#12.2 C6#13.2 C6#14.2 C6#15.2 C6#16.2 C6#17.2 C6#18.2 C6#19.2 C6#20.2 C6#21.2 C6#22.2 C6#23.2 C6#24.2 C6#25.2 C6#26.2 C6#27.2 C6#28.2 C6#29.2 C6#30.2 C6#31.2 C6#32.2 C7.1 C7#2.1 C7#3.1 C7#4.1 C7#5.1 C7#6.1 C7#7.1 C7#8.1 C7#9.1 C7#10.1 C7#11.1 C7#12.1 C7#13.1 C7#14.1 C7#15.1 C7#16.1 C7#17.1 C7#18.1 C7#19.1 C7#20.1 C7#21.1 C7#22.1 C7#23.1 C7#24.1 C7#25.1 C7#26.1 C7#27.1 C7#28.1 C7#29.1 C7#30.1 C7#31.1 C7#32.1 C8.1 C8#2.1 C8#3.1 C8#4.1 C8#5.1 C8#6.1 C8#7.1 C8#8.1 C8#9.1 C8#10.1 C8#11.1 C8#12.1 C8#13.1 C8#14.1 C8#15.1 C8#16.1 C8#17.1 C8#18.1 C8#19.1 C8#20.1 C8#21.1 C8#22.1 C8#23.1 C8#24.1 C8#25.1 C8#26.1 C8#27.1 C8#28.1 C8#29.1 C8#30.1 C8#31.1 C8#32.1 DC1.2 DC1.3 H1.9 H1#2.9 H1#3.9 H1#4.9 H1#5.9 H1#6.9 H1#7.9 H1#8.9 H1#9.9 H1#10.9 H1#11.9 H1#12.9 H1#13.9 H1#14.9 H1#15.9 H1#16.9 H1#17.9 H1#18.9 H1#19.9 H1#20.9 H1#21.9 H1#22.9 H1#23.9 H1#24.9 H1#25.9 H1#26.9 H1#27.9 H1#28.9 H1#29.9 H1#30.9 H1#31.9 H1#32.9 LED1.1 U1.7 U1#2.7 U1#3.7 U1#4.7 U1#5.7 U1#6.7 U1#7.7 U1#8.7 U1#9.7 U1#10.7 U1#11.7 U1#12.7 U1#13.7 U1#14.7 U1#15.7 U1#16.7 U1#17.7 U1#18.7 U1#19.7 U1#20.7 U1#21.7 U1#22.7 U1#23.7 U1#24.7 U1#25.7 U1#26.7 U1#27.7 U1#28.7 U1#29.7 U1#30.7 U1#31.7 U1#32.7 U2.2 U2#2.2 U2#3.2 U2#4.2 U3.1 U3.2 U3.3 U3.4 U3.7 U3#2.1 U3#2.2 U3#2.3 U3#2.4 U3#2.7 U3#3.1 U3#3.2 U3#3.3 U3#3.4 U3#3.7 U3#4.1 U3#4.2 U3#4.3 U3#4.4 U3#4.7 U3#5.1 U3#5.2 U3#5.3 U3#5.4 U3#5.7 U3#6.1 U3#6.2 U3#6.3 U3#6.4 U3#6.7 U3#7.1 U3#7.2 U3#7.3 U3#7.4 U3#7.7 U3#8.1 U3#8.2 U3#8.3 U3#8.4 U3#8.7 U3#9.1 U3#9.2 U3#9.3 U3#9.4 U3#9.7 U3#10.1 U3#10.2 U3#10.3 U3#10.4 U3#10.7 U3#11.1 U3#11.2 U3#11.3 U3#11.4 U3#11.7 U3#12.1 U3#12.2 U3#12.3 U3#12.4 U3#12.7 U3#13.1 U3#13.2 U3#13.3 U3#13.4 U3#13.7 U3#14.1 U3#14.2 U3#14.3 U3#14.4 U3#14.7 U3#15.1 U3#15.2 U3#15.3 U3#15.4 U3#15.7 U3#16.1 U3#16.2 U3#16.3 U3#16.4 U3#16.7 U3#17.1 U3#17.2 U3#17.3 U3#17.4 U3#17.7 U3#18.1 U3#18.2 U3#18.3 U3#18.4 U3#18.7 U3#19.1 U3#19.2 U3#19.3 U3#19.4 U3#19.7 U3#20.1 U3#20.2 U3#20.3 U3#20.4 U3#20.7 U3#21.1 U3#21.2 U3#21.3 U3#21.4 U3#21.7 U3#22.1 U3#22.2 U3#22.3 U3#22.4 U3#22.7 U3#23.1 U3#23.2 U3#23.3 U3#23.4 U3#23.7 U3#24.1 U3#24.2 U3#24.3 U3#24.4 U3#24.7 U3#25.1 U3#25.2 U3#25.3 U3#25.4 U3#25.7 U3#26.1 U3#26.2 U3#26.3 U3#26.4 U3#26.7 U3#27.1 U3#27.2 U3#27.3 U3#27.4 U3#27.7 U3#28.1 U3#28.2 U3#28.3 U3#28.4 U3#28.7 U3#29.1 U3#29.2 U3#29.3 U3#29.4 U3#29.7 U3#30.1 U3#30.2 U3#30.3 U3#30.4 U3#30.7 U3#31.1 U3#31.2 U3#31.3 U3#31.4 U3#31.7 U3#32.1 U3#32.2 U3#32.3 U3#32.4 U3#32.7 U4.8 U4.9 U4.10 U4#2.8 U4#2.9 U4#2.10 U4#3.8 U4#3.9 U4#3.10 U4#4.8 U4#4.9 U4#4.10 U4#5.8 U4#5.9 U4#5.10 U4#6.8 U4#6.9 U4#6.10 U4#7.8 U4#7.9 U4#7.10 U4#8.8 U4#8.9 U4#8.10 U4#9.8 U4#9.9 U4#9.10 U4#10.8 U4#10.9 U4#10.10 U4#11.8 U4#11.9 U4#11.10 U4#12.8 U4#12.9 U4#12.10 U4#13.8 U4#13.9 U4#13.10 U4#14.8 U4#14.9 U4#14.10 U4#15.8 U4#15.9 U4#15.10 U4#16.8 U4#16.9 U4#16.10 U4#17.8 U4#17.9 U4#17.10 U4#18.8 U4#18.9 U4#18.10 U4#19.8 U4#19.9 U4#19.10 U4#20.8 U4#20.9 U4#20.10 U4#21.8 U4#21.9 U4#21.10 U4#22.8 U4#22.9 U4#22.10 U4#23.8 U4#23.9 U4#23.10 U4#24.8 U4#24.9 U4#24.10 U4#25.8 U4#25.9 U4#25.10 U4#26.8 U4#26.9 U4#26.10 U4#27.8 U4#27.9 U4#27.10 U4#28.8 U4#28.9 U4#28.10 U4#29.8 U4#29.9 U4#29.10 U4#30.8 U4#30.9 U4#30.10 U4#31.8 U4#31.9 U4#31.10 U4#32.8 U4#32.9 U4#32.10
DC_7V: C1.1 C2.2 C3.1 C3#2.1 C3#3.1 C3#4.1 D1.2 R1.2 U2.1 U2#2.1 U2#3.1 U2#4.1
I2C_SCL: H7.2 H7#2.2 H7#3.2 H7#4.2 H7#5.2 H7#6.2 H7#7.2 H7#8.2 H7#9.2 H7#10.2 H7#11.2 H7#12.2 H7#13.2 H7#14.2 H7#15.2 H7#16.2 H7#17.2 H7#18.2 H7#19.2 H7#20.2 H7#21.2 H7#22.2 H7#23.2 H7#24.2 H7#25.2 H7#26.2 H7#27.2 H7#28.2 H7#29.2 H7#30.2 H7#31.2 H7#32.2 U1.12 U1#2.12 U1#3.12 U1#4.12 U1#5.12 U1#6.12 U1#7.12 U1#8.12 U1#9.12 U1#10.12 U1#11.12 U1#12.12 U1#13.12 U1#14.12 U1#15.12 U1#16.12 U1#17.12 U1#18.12 U1#19.12 U1#20.12 U1#21.12 U1#22.12 U1#23.12 U1#24.12 U1#25.12 U1#26.12 U1#27.12 U1#28.12 U1#29.12 U1#30.12 U1#31.12 U1#32.12
I2C_SDA: H8.1 H8#2.1 H8#3.1 H8#4.1 H8#5.1 H8#6.1 H8#7.1 H8#8.1 H8#9.1 H8#10.1 H8#11.1 H8#12.1 H8#13.1 H8#14.1 H8#15.1 H8#16.1 H8#17.1 H8#18.1 H8#19.1 H8#20.1 H8#21.1 H8#22.1 H8#23.1 H8#24.1 H8#25.1 H8#26.1 H8#27.1 H8#28.1 H8#29.1 H8#30.1 H8#31.1 H8#32.1 U1.11 U1#2.11 U1#3.11 U1#4.11 U1#5.11 U1#6.11 U1#7.11 U1#8.11 U1#9.11 U1#10.11 U1#11.11 U1#12.11 U1#13.11 U1#14.11 U1#15.11 U1#16.11 U1#17.11 U1#18.11 U1#19.11 U1#20.11 U1#21.11 U1#22.11 U1#23.11 U1#24.11 U1#25.11 U1#26.11 U1#27.11 U1#28.11 U1#29.11 U1#30.11 U1#31.11 U1#32.11
LDO_5V: C4.2 C4#2.2 C4#3.2 C4#4.2 H3.1 H3#2.1 H3#3.1 H3#4.1 U2.3 U2#2.3 U2#3.3 U2#4.3
LED_GREEN: H5.1 H5#2.1 H5#3.1 H5#4.1 H5#5.1 H5#6.1 H5#7.1 H5#8.1 H5#9.1 H5#10.1 H5#11.1 H5#12.1 H5#13.1 H5#14.1 H5#15.1 H5#16.1 H5#17.1 H5#18.1 H5#19.1 H5#20.1 H5#21.1 H5#22.1 H5#23.1 H5#24.1 H5#25.1 H5#26.1 H5#27.1 H5#28.1 H5#29.1 H5#30.1 H5#31.1 H5#32.1 U1.5 U1#2.5 U1#3.5 U1#4.5 U1#5.5 U1#6.5 U1#7.5 U1#8.5 U1#9.5 U1#10.5 U1#11.5 U1#12.5 U1#13.5 U1#14.5 U1#15.5 U1#16.5 U1#17.5 U1#18.5 U1#19.5 U1#20.5 U1#21.5 U1#22.5 U1#23.5 U1#24.5 U1#25.5 U1#26.5 U1#27.5 U1#28.5 U1#29.5 U1#30.5 U1#31.5 U1#32.5
LED_RED: H6.2 H6#2.2 H6#3.2 H6#4.2 H6#5.2 H6#6.2 H6#7.2 H6#8.2 H6#9.2 H6#10.2 H6#11.2 H6#12.2 H6#13.2 H6#14.2 H6#15.2 H6#16.2 H6#17.2 H6#18.2 H6#19.2 H6#20.2 H6#21.2 H6#22.2 H6#23.2 H6#24.2 H6#25.2 H6#26.2 H6#27.2 H6#28.2 H6#29.2 H6#30.2 H6#31.2 H6#32.2 U1.6 U1#2.6 U1#3.6 U1#4.6 U1#5.6 U1#6.6 U1#7.6 U1#8.6 U1#9.6 U1#10.6 U1#11.6 U1#12.6 U1#13.6 U1#14.6 U1#15.6 U1#16.6 U1#17.6 U1#18.6 U1#19.6 U1#20.6 U1#21.6 U1#22.6 U1#23.6 U1#24.6 U1#25.6 U1#26.6 U1#27.6 U1#28.6 U1#29.6 U1#30.6 U1#31.6 U1#32.6
MCO: H1.6 H1#2.6 H1#3.6 H1#4.6 H1#5.6 H1#6.6 H1#7.6 H1#8.6 H1#9.6 H1#10.6 H1#11.6 H1#12.6 H1#13.6 H1#14.6 H1#15.6 H1#16.6 H1#17.6 H1#18.6 H1#19.6 H1#20.6 H1#21.6 H1#22.6 H1#23.6 H1#24.6 H1#25.6 H1#26.6 H1#27.6 H1#28.6 H1#29.6 H1#30.6 H1#31.6 H1#32.6 U1.14 U1#2.14 U1#3.14 U1#4.14 U1#5.14 U1#6.14 U1#7.14 U1#8.14 U1#9.14 U1#10.14 U1#11.14 U1#12.14 U1#13.14 U1#14.14 U1#15.14 U1#16.14 U1#17.14 U1#18.14 U1#19.14 U1#20.14 U1#21.14 U1#22.14 U1#23.14 U1#24.14 U1#25.14 U1#26.14 U1#27.14 U1#28.14 U1#29.14 U1#30.14 U1#31.14 U1#32.14 U4.7 U4#2.7 U4#3.7 U4#4.7 U4#5.7 U4#6.7 U4#7.7 U4#8.7 U4#9.7 U4#10.7 U4#11.7 U4#12.7 U4#13.7 U4#14.7 U4#15.7 U4#16.7 U4#17.7 U4#18.7 U4#19.7 U4#20.7 U4#21.7 U4#22.7 U4#23.7 U4#24.7 U4#25.7 U4#26.7 U4#27.7 U4#28.7 U4#29.7 U4#30.7 U4#31.7 U4#32.7
